# EasyEDA Pro project wukong01-Y003-HTOL.eprj, board PCB1 (continued)
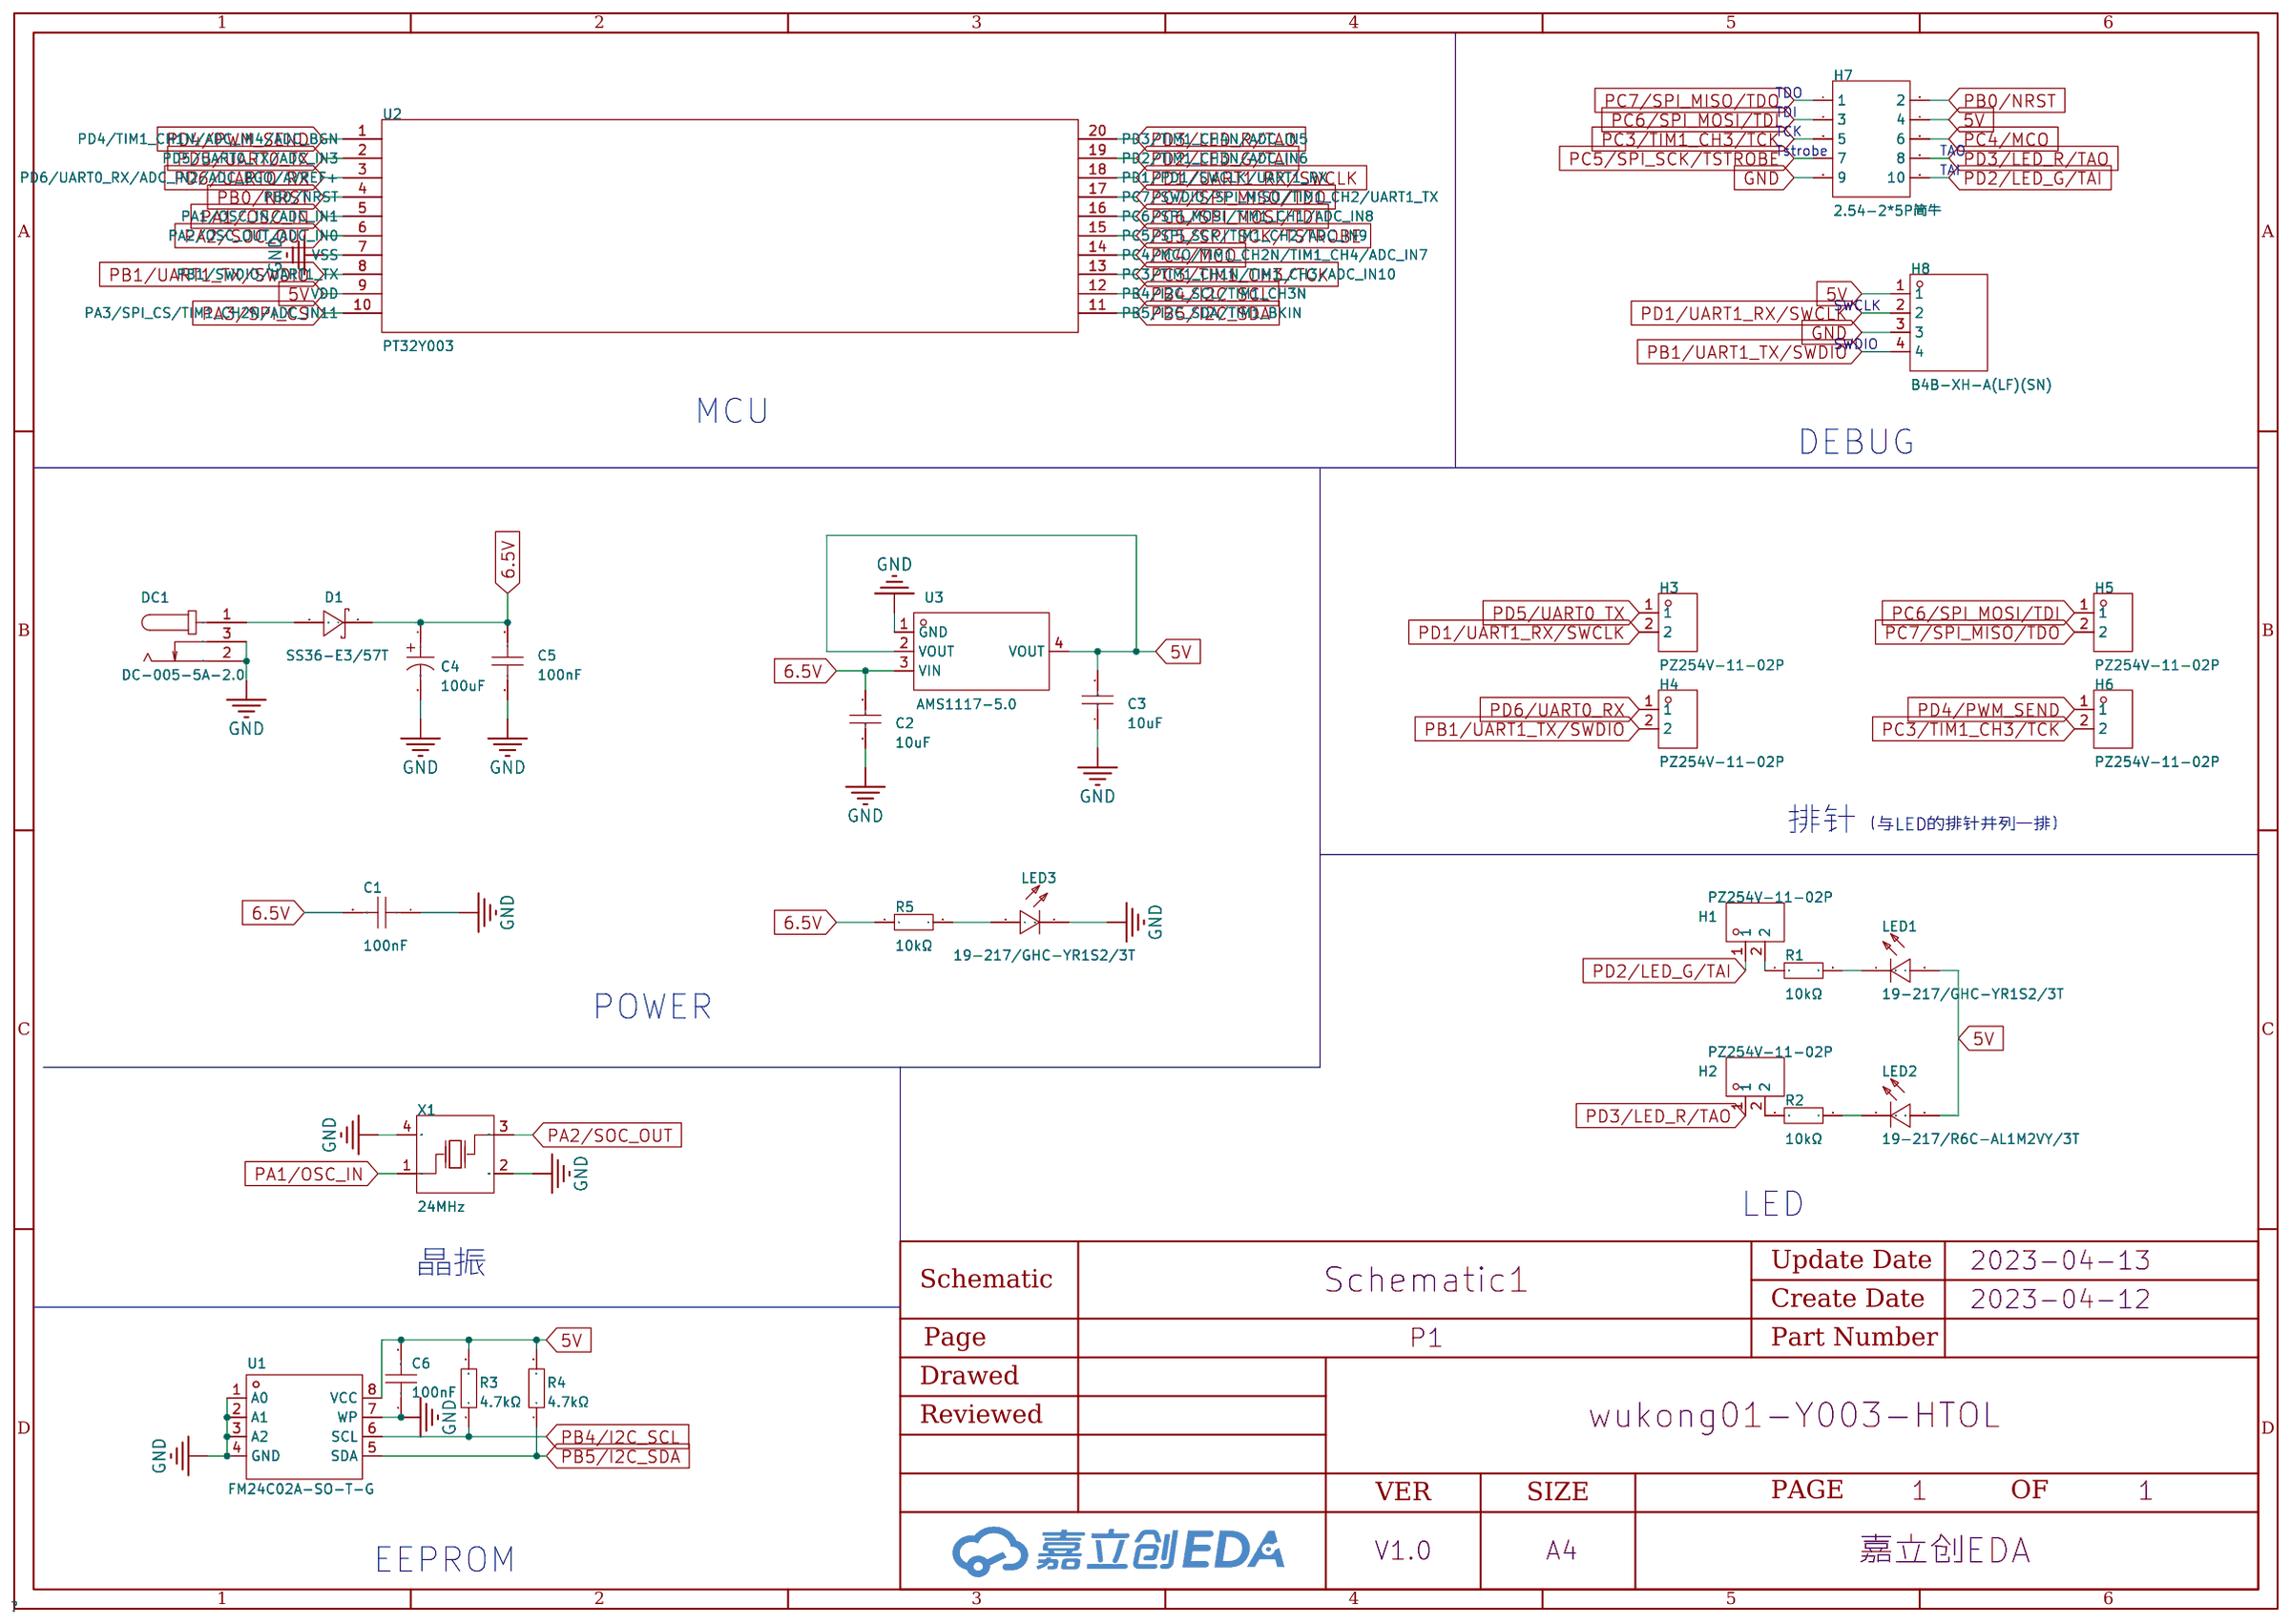
[diagram p0: schematic sheet]
## Routing (per net, layer and track width the routed paths; a pad name or vN(x,y) marks a point on that pad's centre or on a via; arc(x,y) is an arc through that point) (continued)
PD5/UART0_TX: length 1048.5
  Top Layer w0.254: U2#19.2 220.48,62.22 219.96,62.74 219.96,64.01 220.47,64.52 236.85,64.52 237.36,64.01 H3#20.1 ; H3#33.1 41.27,192.79 40.77,193.29 24.38,193.29 23.88,192.79 23.88,191.52 24.4,191 U2#35.2 ; H3#18.1 139.32,21.08 138.81,21.59 122.43,21.59 121.92,21.08 121.92,19.81 122.44,19.29 U2#18.2 ; H3#12.1 237.36,278.64 236.85,279.15 220.47,279.15 219.96,278.64 219.96,277.37 220.48,276.85 U2#16.2 ; U2#29.2 24.4,233.92 23.88,234.44 23.88,235.71 24.38,236.22 40.77,236.22 41.27,235.71 H3#27.1 ; H3#19.1 286.39,64.01 285.88,64.52 269.49,64.52 268.99,64.01 268.99,62.74 269.51,62.22 U2#12.2 ; H3#10.1 139.32,278.64 138.81,279.15 122.43,279.15 121.92,278.64 121.92,277.37 122.44,276.85 U2#11.2 ; H3#32.1 90.3,192.79 89.79,193.29 73.41,193.29 72.9,192.79 72.9,191.52 73.42,191 U2#33.2 ; U2.2 24.4,148.07 23.88,148.59 23.88,149.86 24.38,150.37 40.77,150.37 41.27,149.86 H3#39.1 ; U2#40.2 171.46,148.07 170.94,148.59 170.94,149.86 171.45,150.37 187.83,150.37 188.34,149.86 H3#36.1 ; U2#7.2 171.46,62.22 170.94,62.74 170.94,64.01 171.45,64.52 187.83,64.52 188.34,64.01 H3#15.1 ; H3#38.1 90.3,149.86 89.79,150.37 73.41,150.37 72.9,149.86 72.9,148.59 73.42,148.07 U2#39.2 ; H3#29.1 286.39,235.71 285.88,236.22 269.49,236.22 268.99,235.71 268.99,234.44 269.51,233.92 U2#25.2 ; U2#37.2 269.51,148.07 268.99,148.59 268.99,149.86 269.49,150.37 285.88,150.37 286.39,149.86 H3.1 ; U2#21.2 220.48,19.29 219.96,19.81 219.96,21.08 220.47,21.59 236.85,21.59 237.36,21.08 H3#22.1 ; U2#20.2 24.4,62.22 23.88,62.74 23.88,64.01 24.38,64.52 40.77,64.52 41.27,64.01 H3#13.1 ; H3#26.1 90.3,235.71 89.79,236.22 73.41,236.22 72.9,235.71 72.9,234.44 73.42,233.92 U2#27.2 ; H3#11.1 286.39,278.64 285.88,279.15 269.49,279.15 268.99,278.64 268.99,277.37 269.51,276.85 U2#13.2 ; U2#15.2 122.44,62.22 121.92,62.74 121.92,64.01 122.43,64.52 138.81,64.52 139.32,64.01 H3#14.1 ; H3#21.1 90.3,64.01 89.79,64.52 73.41,64.52 72.9,64.01 72.9,62.74 73.42,62.22 U2#14.2 ; U2#8.2 24.4,105.15 23.88,105.66 23.88,106.93 24.38,107.44 40.77,107.44 41.27,106.93 H3#5.1 ; H3#9.1 188.34,278.64 187.83,279.15 171.45,279.15 170.94,278.64 170.94,277.37 171.46,276.85 U2#10.2 ; H3#37.1 139.32,149.86 138.81,150.37 122.43,150.37 121.92,149.86 121.92,148.59 122.44,148.07 U2#36.2 ; U2#6.2 171.46,105.15 170.94,105.66 170.94,106.93 171.45,107.44 187.83,107.44 188.34,106.93 H3#2.1 ; H3#35.1 286.39,192.79 285.88,193.29 269.49,193.29 268.99,192.79 268.99,191.52 269.51,191 U2#31.2 ; H3#31.1 139.32,192.79 138.81,193.29 122.43,193.29 121.92,192.79 121.92,191.52 122.44,191 U2#30.2 ; U2#22.2 24.4,19.29 23.88,19.81 23.88,21.08 24.38,21.59 40.77,21.59 41.27,21.08 H3#17.1 ; H3#8.1 90.3,278.64 89.79,279.15 73.41,279.15 72.9,278.64 72.9,277.37 73.42,276.85 U2#9.2 ; U2#4.2 220.48,105.15 219.96,105.66 219.96,106.93 220.47,107.44 236.85,107.44 237.36,106.93 H3#6.1 ; U2#5.2 73.42,105.15 72.9,105.66 72.9,106.93 73.41,107.44 89.79,107.44 90.3,106.93 H3#4.1 ; H3#23.1 90.3,21.08 89.79,21.59 73.41,21.59 72.9,21.08 72.9,19.81 73.42,19.29 U2#23.2 ; H3#3.1 139.32,106.93 138.81,107.44 122.43,107.44 121.92,106.93 121.92,105.66 122.44,105.15 U2#2.2 ; U2#3.2 269.51,105.15 268.99,105.66 268.99,106.93 269.49,107.44 285.88,107.44 286.39,106.93 H3#7.1 ; H3#30.1 188.34,192.79 187.83,193.29 171.45,193.29 170.94,192.79 170.94,191.52 171.46,191 U2#34.2 ; U2#32.2 220.48,191 219.96,191.52 219.96,192.79 220.47,193.29 236.85,193.29 237.36,192.79 H3#34.1 ; U2#38.2 220.48,148.07 219.96,148.59 219.96,149.86 220.47,150.37 236.85,150.37 237.36,149.86 H3#40.1 ; H3#16.1 188.34,21.08 187.83,21.59 171.45,21.59 170.94,21.08 170.94,19.81 171.46,19.29 U2#17.2 ; U2#28.2 171.46,233.92 170.94,234.44 170.94,235.71 171.45,236.22 187.83,236.22 188.34,235.71 H3#24.1 ; U2#26.2 220.48,233.92 219.96,234.44 219.96,235.71 220.47,236.22 236.85,236.22 237.36,235.71 H3#28.1 ; H3#25.1 139.32,235.71 138.81,236.22 122.43,236.22 121.92,235.71 121.92,234.44 122.44,233.92 U2#24.2
PD6/UART0_RX: length 1164.6
  Top Layer w0.254: U2#34.3 174.01,190.37 171.2,190.37 170.05,191.52 170.05,193.17 170.81,193.93 188.98,193.93 190.37,195.33 H4#29.1 ; 26.97,233.27 26.95,233.3 24.13,233.3 22.99,234.44 22.99,236.09 23.75,236.86 41.91,236.86 43.31,238.25 H4#27.1 ; H4#2.1 92.33,109.47 90.93,108.08 72.77,108.08 72.01,107.32 72.01,105.66 73.15,104.52 75.97,104.52 U2#5.3 ; H4#18.1 288.42,66.55 287.02,65.15 268.86,65.15 268.1,64.39 268.1,62.74 269.24,61.59 272.06,61.59 U2#12.3 ; H4#9.1 141.35,281.18 139.95,279.78 121.79,279.78 121.03,279.02 121.03,277.37 122.17,276.23 124.99,276.23 U2#11.3 ; H4#32.1 239.4,195.33 238,193.93 219.84,193.93 219.07,193.17 219.07,191.52 220.22,190.37 223.04,190.37 U2#32.3 ; U2#37.3 272.06,147.45 269.24,147.45 268.1,148.59 268.1,150.24 268.86,151 287.02,151 288.42,152.4 H4#40.1 ; U2.3 26.95,147.45 24.13,147.45 22.99,148.59 22.99,150.24 23.75,151 41.91,151 43.31,152.4 H4#39.1 ; H4#20.1 92.33,23.62 90.93,22.23 72.77,22.23 72.01,21.46 72.01,19.81 73.15,18.67 75.97,18.67 U2#23.3 ; U2#14.3 75.97,61.59 73.15,61.59 72.01,62.74 72.01,64.39 72.77,65.15 90.93,65.15 92.33,66.55 H4#15.1 ; U2#16.3 223.04,276.23 220.22,276.23 219.07,277.37 219.07,279.02 219.84,279.78 238,279.78 239.4,281.18 H4#11.1 ; U2#2.3 124.99,104.52 122.17,104.52 121.03,105.66 121.03,107.32 121.79,108.08 139.95,108.08 141.35,109.47 H4#3.1 ; H4#6.1 288.42,109.47 287.02,108.08 268.86,108.08 268.1,107.32 268.1,105.66 269.24,104.52 272.06,104.52 U2#3.3 ; U2#7.3 174.01,61.59 171.2,61.59 170.05,62.74 170.05,64.39 170.81,65.15 188.98,65.15 190.37,66.55 H4#12.1 ; U2#15.3 124.99,61.59 122.17,61.59 121.03,62.74 121.03,64.39 121.79,65.15 139.95,65.15 141.35,66.55 H4#16.1 ; U2#17.3 174.01,18.67 171.2,18.67 170.05,19.81 170.05,21.46 170.81,22.23 188.98,22.23 190.37,23.62 H4#17.1 ; U2#40.3 174.01,147.45 171.2,147.45 170.05,148.59 170.05,150.24 170.81,151 188.98,151 190.37,152.4 H4#35.1 ; H4#28.1 288.42,238.25 287.02,236.86 268.86,236.86 268.1,236.09 268.1,234.44 269.24,233.3 272.06,233.3 272.08,233.27 ; H4#8.1 190.37,281.18 188.98,279.78 170.81,279.78 170.05,279.02 170.05,277.37 171.2,276.23 174.01,276.23 U2#10.3 ; H4#14.1 43.31,23.62 41.91,22.23 23.75,22.23 22.99,21.46 22.99,19.81 24.13,18.67 26.95,18.67 U2#22.3 ; H4#5.1 43.31,109.47 41.91,108.08 23.75,108.08 22.99,107.32 22.99,105.66 24.13,104.52 26.95,104.52 U2#8.3 ; H4#37.1 141.35,152.4 139.95,151 121.79,151 121.03,150.24 121.03,148.59 122.17,147.45 124.99,147.45 U2#36.3 ; H4#31.1 141.35,195.33 139.95,193.93 121.79,193.93 121.03,193.17 121.03,191.52 122.17,190.37 124.99,190.37 U2#30.3 ; U2#35.3 26.95,190.37 24.13,190.37 22.99,191.52 22.99,193.17 23.75,193.93 41.91,193.93 43.31,195.33 H4#33.1 ; 125.02,233.27 124.99,233.3 122.17,233.3 121.03,234.44 121.03,236.09 121.79,236.86 139.95,236.86 141.35,238.25 H4#25.1 ; H4#24.1 92.33,238.25 90.93,236.86 72.77,236.86 72.01,236.09 72.01,234.44 73.15,233.3 75.97,233.3 76,233.27 ; H4#30.1 92.33,195.33 90.93,193.93 72.77,193.93 72.01,193.17 72.01,191.52 73.15,190.37 75.97,190.37 U2#33.3 ; H4.1 190.37,109.47 188.98,108.08 170.81,108.08 170.05,107.32 170.05,105.66 171.2,104.52 174.01,104.52 U2#6.3 ; U2#13.3 272.06,276.23 269.24,276.23 268.1,277.37 268.1,279.02 268.86,279.78 287.02,279.78 288.42,281.18 H4#10.1 ; U2#19.3 223.04,61.59 220.22,61.59 219.07,62.74 219.07,64.39 219.84,65.15 238,65.15 239.4,66.55 H4#19.1 ; H4#26.1 239.4,238.25 238,236.86 219.84,236.86 219.07,236.09 219.07,234.44 220.22,233.3 223.04,233.3 223.06,233.27 ; U2#20.3 26.95,61.59 24.13,61.59 22.99,62.74 22.99,64.39 23.75,65.15 41.91,65.15 43.31,66.55 H4#13.1 ; U2#38.3 223.04,147.45 220.22,147.45 219.07,148.59 219.07,150.24 219.84,151 238,151 239.4,152.4 H4#38.1 ; U2#4.3 223.04,104.52 220.22,104.52 219.07,105.66 219.07,107.32 219.84,108.08 238,108.08 239.4,109.47 H4#4.1 ; H4#7.1 92.33,281.18 90.93,279.78 72.77,279.78 72.01,279.02 72.01,277.37 73.15,276.23 75.97,276.23 U2#9.3 ; H4#34.1 288.42,195.33 287.02,193.93 268.86,193.93 268.1,193.17 268.1,191.52 269.24,190.37 272.06,190.37 U2#31.3 ; H4#23.1 190.37,238.25 188.98,236.86 170.81,236.86 170.05,236.09 170.05,234.44 171.2,233.3 174.01,233.3 174.04,233.27 ; U2#39.3 75.97,147.45 73.15,147.45 72.01,148.59 72.01,150.24 72.77,151 90.93,151 92.33,152.4 H4#36.1 ; U2#18.3 124.99,18.67 122.17,18.67 121.03,19.81 121.03,21.46 121.79,22.23 139.95,22.23 141.35,23.62 H4#22.1 ; U2#21.3 223.04,18.67 220.22,18.67 219.07,19.81 219.07,21.46 219.84,22.23 238,22.23 239.4,23.62 H4#21.1
$1N849: length 124.6
  Top Layer w0.254: R1#33.2 33.6,179.01 LED1#31.1 ; LED1#10.1 229.69,50.23 R1#10.2 ; R1#34.2 131.64,179.01 LED1#29.1 ; R1#19.2 229.69,7.3 LED1#15.1 ; R1#15.2 180.66,7.3 LED1#16.1 ; R1#30.2 180.66,179.01 LED1#33.1 ; 82.69,264.8 82.62,264.86 LED1#7.1 ; LED1#23.1 131.64,221.93 R1#29.2 ; LED1#40.1 82.62,136.08 R1#38.2 ; R1#12.2 180.66,50.23 LED1#14.1 ; R1#28.2 33.6,221.93 LED1#25.1 ; R1#27.2 82.62,221.93 LED1#28.1 ; R1#32.2 82.62,179.01 LED1#34.1 ; LED1.1 131.64,93.16 R1#6.2 ; R1#3.2 278.71,93.16 LED1#4.1 ; LED1#22.1 82.62,50.23 R1#17.2 ; 180.73,264.8 180.66,264.86 LED1#9.1 ; R1#31.2 278.71,179.01 LED1#32.1 ; R1#5.2 33.6,93.16 LED1#3.1 ; LED1#18.1 33.6,50.23 R1#21.2 ; R1#39.2 33.6,136.08 LED1#37.1 ; R1#22.2 33.6,7.3 LED1#12.1 ; R1#25.2 180.66,221.93 LED1#27.1 ; R1#16.2 278.71,50.23 LED1#17.1 ; LED1#26.1 278.71,221.93 R1#26.2 ; LED1#24.1 229.69,221.93 R1#24.2 ; LED1#20.1 131.64,7.3 R1#20.2 ; R1#35.2 229.69,136.08 LED1#36.1 ; R1.2 229.69,93.16 LED1#2.1 ; R1#14.2 229.69,179.01 LED1#30.1 ; R1#36.2 180.66,136.08 LED1#39.1 ; LED1#35.1 131.64,136.08 R1#40.2 ; R1#37.2 278.71,136.08 LED1#38.1 ; R1#4.2 82.62,93.16 LED1#6.1 ; LED1#21.1 82.62,7.3 R1#23.2 ; 229.75,264.8 229.69,264.86 LED1#11.1 ; 131.71,264.8 131.64,264.86 LED1#8.1 ; 278.77,264.8 278.71,264.86 LED1#13.1 ; R1#2.2 180.66,93.16 LED1#5.1 ; LED1#19.1 131.64,50.23 R1#18.2
$1N852: length 120.1
  Top Layer w0.254: LED2#39.2 226.92,137.66 R2#35.2 ; LED2#32.2 275.94,223.52 R2#25.2 ; R2#13.2 177.89,51.81 LED2#23.2 ; LED2#19.2 128.87,8.89 R2#17.2 ; R2#2.2 177.89,94.74 LED2#9.2 ; LED2#31.2 177.89,223.52 R2#24.2 ; R2#10.2 226.92,51.81 LED2#20.2 ; LED2#21.2 79.85,8.89 R2#22.2 ; LED2#16.2 30.83,8.89 R2#19.2 ; R2#14.2 177.89,8.89 LED2#18.2 ; R2#33.2 128.87,180.59 LED2#36.2 ; LED2#24.2 226.92,8.89 R2#21.2 ; LED2#15.2 226.92,266.44 R2#11.2 ; LED2#11.2 79.85,266.44 R2#7.2 ; LED2#13.2 128.87,266.44 R2#8.2 ; R2#34.2 79.85,180.59 LED2#34.2 ; LED2#6.2 79.85,94.74 R2#6.2 ; R2#31.2 275.94,180.59 LED2#38.2 ; R2#18.2 30.83,51.81 LED2#26.2 ; R2#27.2 128.87,223.52 LED2#30.2 ; LED2#35.2 30.83,180.59 R2#32.2 ; R2#9.2 177.89,266.44 LED2#12.2 ; R2#39.2 128.87,137.66 LED2#2.2 ; LED2#4.2 275.94,137.66 R2#37.2 ; R2#36.2 177.89,137.66 LED2#3.2 ; LED2#17.2 79.85,51.81 R2#20.2 ; R2.2 226.92,94.74 LED2#5.2 ; LED2#28.2 79.85,223.52 R2#28.2 ; R2#12.2 275.94,266.44 LED2#14.2 ; LED2#7.2 30.83,94.74 R2#4.2 ; LED2#33.2 226.92,180.59 R2#29.2 ; R2#3.2 275.94,94.74 LED2#10.2 ; LED2.2 30.83,137.66 R2#38.2 ; LED2#22.2 128.87,51.81 R2#16.2 ; LED2#37.2 177.89,180.59 R2#30.2 ; LED2#8.2 128.87,94.74 R2#5.2 ; LED2#25.2 275.94,51.81 R2#15.2 ; LED2#29.2 30.83,223.52 R2#26.2 ; R2#23.2 226.92,223.52 LED2#27.2 ; R2#40.2 79.85,137.66 LED2#40.2
$1N3085: length 866.8
  Top Layer w0.254: H1#17.2 196.09,56.39 196.6,55.88 196.6,51.05 195.71,50.17 R1#12.1 ; R1#18.1 146.69,50.17 147.57,51.05 147.57,55.88 147.07,56.39 H1#24.2 ; R1#35.1 244.73,136.02 245.62,136.91 245.62,141.73 245.11,142.24 H1#40.2 ; R1#5.1 48.64,93.09 49.53,93.98 49.53,98.81 49.02,99.31 H1#7.2 ; H1#32.2 196.09,185.17 196.6,184.66 196.6,179.83 195.71,178.94 R1#30.1 ; H1#8.2 147.07,99.31 147.57,98.81 147.57,93.98 146.69,93.09 R1#6.1 ; R1#22.1 48.64,7.24 49.53,8.13 49.53,12.95 49.02,13.46 H1#23.2 ; R1#29.1 146.69,221.87 147.57,222.76 147.57,227.58 147.07,228.09 H1#30.2 ; R1#16.1 293.75,50.17 294.64,51.05 294.64,55.88 294.13,56.39 H1#22.2 ; R1#11.1 293.75,264.8 294.64,265.68 294.64,270.51 294.13,271.02 H1#13.2 ; H1#11.2 196.09,271.02 196.6,270.51 196.6,265.68 195.71,264.8 R1#8.1 ; H1#25.2 147.07,13.46 147.57,12.95 147.57,8.13 146.69,7.24 R1#20.1 ; R1#23.1 97.66,7.24 98.55,8.13 98.55,12.95 98.04,13.46 H1#20.2 ; R1#24.1 244.73,221.87 245.62,222.76 245.62,227.58 245.11,228.09 H1#28.2 ; H1#31.2 294.13,228.09 294.64,227.58 294.64,222.76 293.75,221.87 R1#26.1 ; H1#10.2 98.04,271.02 98.55,270.51 98.55,265.68 97.66,264.8 R1#7.1 ; H1#18.2 196.09,13.46 196.6,12.95 196.6,8.13 195.71,7.24 R1#15.1 ; R1#3.1 293.75,93.09 294.64,93.98 294.64,98.81 294.13,99.31 H1#9.2 ; H1#21.2 245.11,13.46 245.62,12.95 245.62,8.13 244.73,7.24 R1#19.1 ; H1#35.2 49.02,185.17 49.53,184.66 49.53,179.83 48.64,178.94 R1#33.1 ; H1#5.2 98.04,99.31 98.55,98.81 98.55,93.98 97.66,93.09 R1#4.1 ; H1#36.2 147.07,185.17 147.57,184.66 147.57,179.83 146.69,178.94 R1#34.1 ; R1#32.1 97.66,178.94 98.55,179.83 98.55,184.66 98.04,185.17 H1#33.2 ; H1#16.2 245.11,271.02 245.62,270.51 245.62,265.68 244.73,264.8 R1#13.1 ; H1.2 49.02,142.24 49.53,141.73 49.53,136.91 48.64,136.02 R1#39.1 ; R1#28.1 48.64,221.87 49.53,222.76 49.53,227.58 49.02,228.09 H1#29.2 ; H1#37.2 294.13,185.17 294.64,184.66 294.64,179.83 293.75,178.94 R1#31.1 ; H1#6.2 245.11,99.31 245.62,98.81 245.62,93.98 244.73,93.09 R1.1 ; H1#26.2 196.09,228.09 196.6,227.58 196.6,222.76 195.71,221.87 R1#25.1 ; R1#36.1 195.71,136.02 196.6,136.91 196.6,141.73 196.09,142.24 H1#38.2 ; H1#14.2 49.02,56.39 49.53,55.88 49.53,51.05 48.64,50.17 R1#21.1 ; R1#40.1 146.69,136.02 147.57,136.91 147.57,141.73 147.07,142.24 H1#2.2 ; H1#19.2 245.11,56.39 245.62,55.88 245.62,51.05 244.73,50.17 R1#10.1 ; R1#2.1 195.71,93.09 196.6,93.98 196.6,98.81 196.09,99.31 H1#4.2 ; R1#14.1 244.73,178.94 245.62,179.83 245.62,184.66 245.11,185.17 H1#34.2 ; R1#17.1 97.66,50.17 98.55,51.05 98.55,55.88 98.04,56.39 H1#15.2 ; H1#3.2 294.13,142.24 294.64,141.73 294.64,136.91 293.75,136.02 R1#37.1 ; R1#9.1 146.69,264.8 147.57,265.68 147.57,270.51 147.07,271.02 H1#12.2 ; R1#27.1 97.66,221.87 98.55,222.76 98.55,227.58 98.04,228.09 H1#27.2 ; R1#38.1 97.66,136.02 98.55,136.91 98.55,141.73 98.04,142.24 H1#39.2
$1N3176: length 990
  Top Layer w0.254: v1(197.48,223.52) 197.48,229.87 196.72,230.63 H2#25.2 ; v1(244.73,51.82) 244.7,51.84 231.27,51.84 R2#10.1 ; v1(148.46,266.45) 148.46,272.8 147.7,273.56 H2#11.2 ; H2#5.2 98.68,101.85 99.44,101.09 v1(99.44,94.74) ; H2#9.2 98.68,273.56 99.44,272.8 v1(99.44,266.45) ; v1(197.48,8.89) 197.48,15.24 196.72,16 H2#16.2 ; v1(97.66,8.89) 97.64,8.92 84.2,8.92 R2#22.1 ; v1(48.64,137.67) 48.62,137.69 35.18,137.69 R2#38.1 ; v1(295.53,180.59) 295.53,186.94 294.77,187.71 H2#36.2 ; H2#30.2 294.77,230.63 295.53,229.87 v1(295.53,223.52) ; v1(246.51,223.52) 246.51,229.87 245.75,230.63 H2#26.2 ; H2#38.2 245.75,144.78 246.51,144.02 v1(246.51,137.67) ; v1(197.48,180.59) 197.48,186.94 196.72,187.71 H2#31.2 ; R2#20.1 84.2,51.84 97.64,51.84 v1(97.66,51.82) ; v1(50.42,223.52) 50.42,229.87 49.66,230.63 H2#28.2 ; H2#22.2 245.75,16 246.51,15.24 v1(246.51,8.89) ; R2#5.1 133.22,94.77 146.66,94.77 v1(146.69,94.74) ; v1(48.64,8.89) 48.62,8.92 35.18,8.92 R2#19.1 ; v1(295.53,94.74) 295.53,101.09 294.77,101.85 H2#8.2 ; R2#34.1 84.2,180.62 97.64,180.62 v1(97.66,180.59) ; v1(99.44,137.67) 99.44,144.02 98.68,144.78 H2#39.2 ; v1(48.64,180.59) 48.62,180.62 35.18,180.62 R2#32.1 ; R2#9.1 182.25,266.47 195.68,266.47 v1(195.71,266.45) ; H2#24.2 98.68,16 99.44,15.24 v1(99.44,8.89) ; R2#29.1 231.27,180.62 244.7,180.62 v1(244.73,180.59) ; H2#19.2 147.7,16 148.46,15.24 v1(148.46,8.89) ; R2#23.1 231.27,223.55 244.7,223.55 v1(244.73,223.52) ; R2#2.1 182.25,94.77 195.68,94.77 v1(195.71,94.74) ; v1(146.69,137.67) 146.66,137.69 133.22,137.69 R2#39.1 ; v1(50.42,180.59) 50.42,186.94 49.66,187.71 H2#34.2 ; v1(295.53,266.45) 295.53,272.8 294.77,273.56 H2#12.2 ; v1(97.66,137.67) 97.64,137.69 84.2,137.69 R2#40.1 ; R2#13.1 182.25,51.84 195.68,51.84 v1(195.71,51.82) ; H2#32.2 245.75,187.71 246.51,186.94 v1(246.51,180.59) ; v1(50.42,94.74) 50.42,101.09 49.66,101.85 H2#6.2 ; H2#33.2 98.68,187.71 99.44,186.94 v1(99.44,180.59) ; H2#20.2 49.66,16 50.42,15.24 v1(50.42,8.89) ; v1(146.69,180.59) 146.66,180.62 133.22,180.62 R2#33.1 ; v1(148.46,223.52) 148.46,229.87 147.7,230.63 H2#29.2 ; H2#3.2 196.72,101.85 197.48,101.09 v1(197.48,94.74) ; v1(246.51,266.45) 246.51,272.8 245.75,273.56 H2#14.2 ; v1(293.75,266.45) 293.73,266.47 280.29,266.47 R2#12.1 ; v1(195.71,180.59) 195.68,180.62 182.25,180.62 R2#30.1 ; H2#4.2 245.75,101.85 246.51,101.09 v1(246.51,94.74) ; R2#31.1 280.29,180.62 293.73,180.62 v1(293.75,180.59) ; R2#15.1 280.29,51.84 293.73,51.84 v1(293.75,51.82) ; v1(244.73,94.74) 244.7,94.77 231.27,94.77 R2.1 ; v1(295.53,51.82) 295.53,58.17 294.77,58.93 H2#23.2 ; v1(48.64,94.74) 48.62,94.77 35.18,94.77 R2#4.1 ; H2#15.2 196.72,58.93 197.48,58.17 v1(197.48,51.82) ; v1(50.42,137.67) 50.42,144.02 49.66,144.78 H2#40.2 ; H2#18.2 98.68,58.93 99.44,58.17 v1(99.44,51.82) ; R2#21.1 231.27,8.92 244.7,8.92 v1(244.73,8.89) ; v1(97.66,266.45) 97.64,266.47 84.2,266.47 R2#7.1 ; v1(197.48,266.45) 197.48,272.8 196.72,273.56 H2#10.2 ; v1(48.64,223.52) 48.62,223.55 35.18,223.55 R2#26.1 ; v1(148.46,137.67) 148.46,144.02 147.7,144.78 H2.2 ; v1(146.69,8.89) 146.66,8.92 133.22,8.92 R2#17.1 ; H2#37.2 196.72,144.78 197.48,144.02 v1(197.48,137.67) ; R2#28.1 84.2,223.55 97.64,223.55 v1(97.66,223.52) ; v1(146.69,223.52) 146.66,223.55 133.22,223.55 R2#27.1 ; R2#25.1 280.29,223.55 293.73,223.55 v1(293.75,223.52) ; R2#8.1 133.22,266.47 146.66,266.47 v1(146.69,266.45) ; v1(195.71,223.52) 195.68,223.55 182.25,223.55 R2#24.1 ; v1(244.73,137.67) 244.7,137.69 231.27,137.69 R2#35.1 ; R2#36.1 182.25,137.69 195.68,137.69 v1(195.71,137.67) ; v1(148.46,51.82) 148.46,58.17 147.7,58.93 H2#21.2 ; R2#14.1 182.25,8.92 195.68,8.92 v1(195.71,8.89) ; R2#6.1 84.2,94.77 97.64,94.77 v1(97.66,94.74) ; v1(295.53,137.67) 295.53,144.02 294.77,144.78 H2#2.2 ; H2#13.2 49.66,58.93 50.42,58.17 v1(50.42,51.82) ; H2#27.2 98.68,230.63 99.44,229.87 v1(99.44,223.52) ; R2#11.1 231.27,266.47 244.7,266.47 v1(244.73,266.45) ; v1(148.46,180.59) 148.46,186.94 147.7,187.71 H2#35.2 ; H2#7.2 147.7,101.85 148.46,101.09 v1(148.46,94.74) ; R2#16.1 133.22,51.84 146.66,51.84 v1(146.69,51.82) ; R2#18.1 35.18,51.84 48.62,51.84 v1(48.64,51.82) ; H2#17.2 245.75,58.93 246.51,58.17 v1(246.51,51.82) ; v1(293.75,94.74) 293.73,94.77 280.29,94.77 R2#3.1 ; v1(293.75,137.67) 293.73,137.69 280.29,137.69 R2#37.1
  Bottom Layer w0.254: v1(295.53,223.52) v1(293.75,223.52) ; v1(50.42,94.74) v1(48.64,94.74) ; v1(197.48,51.82) v1(195.71,51.82) ; v1(295.53,137.67) v1(293.75,137.67) ; v1(246.51,51.82) v1(244.73,51.82) ; v1(197.48,223.52) v1(195.71,223.52) ; v1(295.53,51.82) v1(293.75,51.82) ; v1(148.46,137.67) v1(146.69,137.67) ; v1(99.44,51.82) v1(97.66,51.82) ; v1(148.46,266.45) v1(146.69,266.45) ; v1(295.53,180.59) v1(293.75,180.59) ; v1(246.51,180.59) v1(244.73,180.59) ; v1(99.44,180.59) v1(97.66,180.59) ; v1(197.48,180.59) v1(195.71,180.59) ; v1(148.46,180.59) v1(146.69,180.59) ; v1(50.42,223.52) v1(48.64,223.52) ; v1(148.46,51.82) v1(146.69,51.82) ; v1(246.51,94.74) v1(244.73,94.74) ; v1(99.44,8.89) v1(97.66,8.89) ; v1(50.42,137.67) v1(48.64,137.67) ; v1(197.48,8.89) v1(195.71,8.89) ; v1(197.48,137.67) v1(195.71,137.67) ; v1(99.44,266.45) v1(97.66,266.45) ; v1(246.51,8.89) v1(244.73,8.89) ; v1(148.46,8.89) v1(146.69,8.89) ; v1(99.44,94.74) v1(97.66,94.74) ; v1(50.42,51.82) v1(48.64,51.82) ; v1(99.44,137.67) v1(97.66,137.67) ; v1(50.42,8.89) v1(48.64,8.89) ; v1(197.48,266.45) v1(195.71,266.45) ; v1(148.46,223.52) v1(146.69,223.52) ; v1(246.51,137.67) v1(244.73,137.67) ; v1(246.51,223.52) v1(244.73,223.52) ; v1(197.48,94.74) v1(195.71,94.74) ; v1(295.53,94.74) v1(293.75,94.74) ; v1(99.44,223.52) v1(97.66,223.52) ; v1(50.42,180.59) v1(48.64,180.59) ; v1(295.53,266.45) v1(293.75,266.45) ; v1(148.46,94.74) v1(146.69,94.74) ; v1(246.51,266.45) v1(244.73,266.45)
$1N6085: length 2.8
  Top Layer w0.5: LED3.2 28.19,285.03 R5.1
$1N6296: length 5.7
  Top Layer w0.5: D1.1 12.77,289.49 12.77,295.07

## Copper pours and planes (outline as drawn; the poured copper is in the pictures)
GND on Top Layer: 0,313 310,313 310,0 0,0
GND on Bottom Layer: 0,313 310,313 310,0 0,0

## Text on the board
Top Silkscreen Layer: 澎湃微电子
